# EasyEDA Pro project AgOopenHardwareMicro.eprj, board PCB_AIO v4.5 Micro AMP 2024 Robin
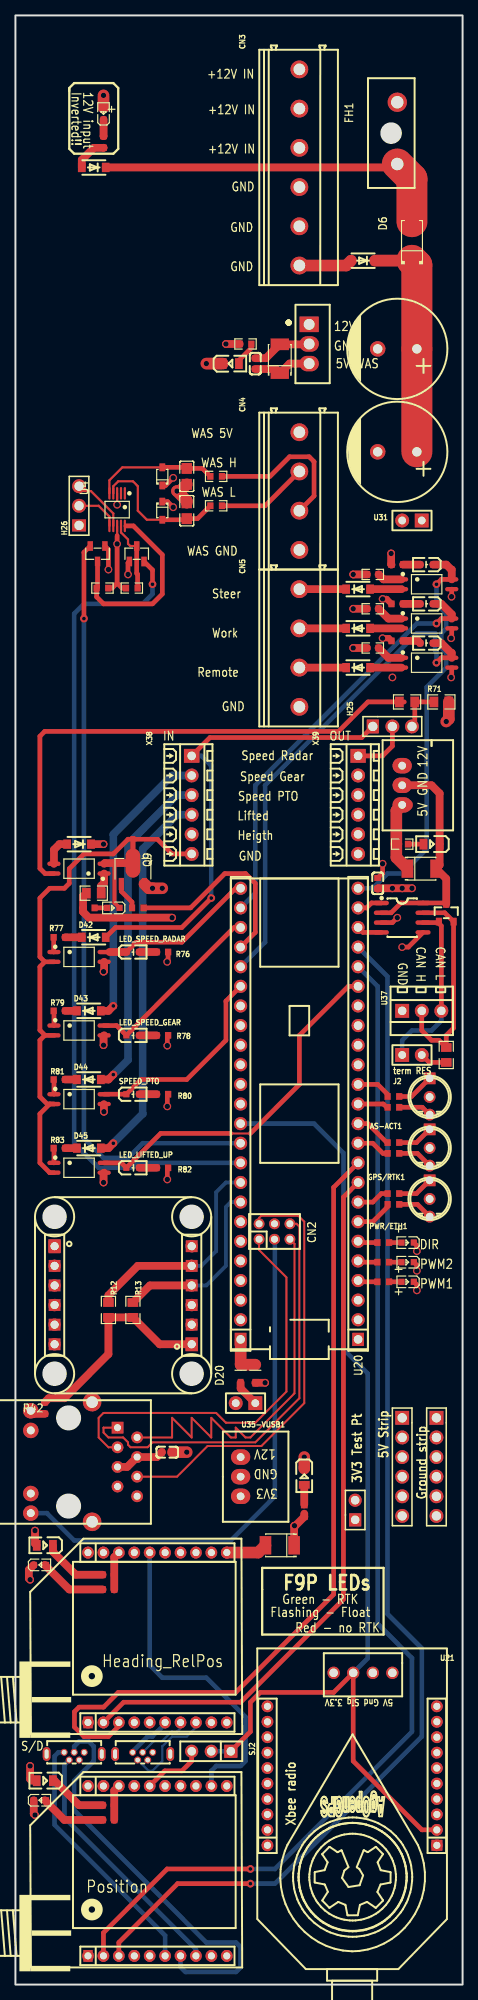
[diagram p12: board, top side]
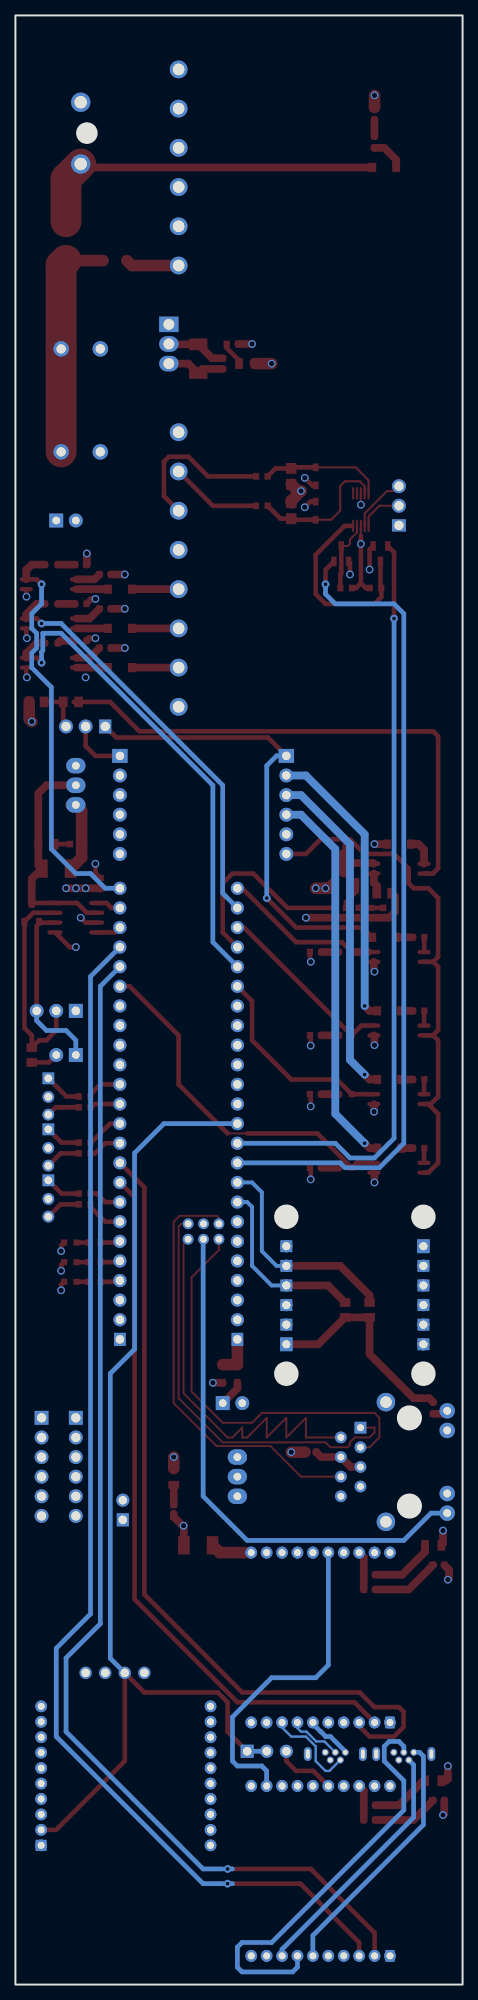
[diagram p13: board, bottom side, seen from below]

Outline 58 x 255 mm; copper layers: Top Layer, Inner1, Inner2, Bottom Layer. Coordinates in mm from the lower left corner of the outline.
Outline path: rectangle 0,255 58,0
Stack: Top Layer 0.035mm / Dielectric1 0.48mm PP er 4.5 / Inner1 0.035mm / Dielectric2 0.48mm FR4 er 4.5 / Inner2 0.035mm / Dielectric3 0.48mm PP er 4.5 / Bottom Layer 0.035mm

## Design rules (mm)
template: User Custom Config
spacing Default (default): track to track 0.201, other pairs 0 to 0.201
spacing 5v: track to track 0.201, other pairs 0 to 0.201
spacing 12v: track to track 0.3, other pairs 0 to 0.3
spacing sec: track to track 0.201, other pairs 0 to 0.201
track width Default (default): min 0.254, default 0.254, max 25.4
track width 5v: min 0.599, default 0.599, max 25.4
track width 12v: min 1.501, default 1.501, max 25.4
track width sec: min 0.5, default 0.5, max 25.4
differential pair differentialPair (default): width min 0.127, default 0.254, max 2.54; gap min 0.152, default 0.152
via Default (default): diameter min 0.61, default 0.61, max 100.025; hole min 0.305, default 0.305, max 59.995
via 5v: diameter min 0.8, default 0.8, max 100.025; hole min 0.399, default 0.399, max 59.995
via 12v: diameter min 1.001, default 1.001, max 100.025; hole min 0.599, default 0.599, max 59.995
via sec: diameter min 0.8, default 0.8, max 100.025; hole min 0.399, default 0.399, max 59.995
net 5V_WAS uses 5v, gge462106(1)
net 5V2 uses 5v, gge462106(1)
net +12V_BOARD uses 12v, gge462106
net +12V_IN uses 12v, gge462106(1)
net GND uses gge1424176(1)
net 3V3 uses gge462106
net 3.3V uses gge462106
pour e1032 uses gge462106

## Placement (name value [footprint] x y rotation side)
AS-ACT1  DY-339URUYGW/SN  [footprint_04ce]  53.73 115 270 top
C7  10nF  [footprint_89fb]  22.22 195.31 90 top
C8  100uF  [footprint_7bcb]  34.29 56.88 180 top
C9  100uF  [footprint_7bcb]  52.71 144.51 0 top
C10  100uF  [footprint_7bcb]  34.29 210.55 90 top
C11  100nF_CAN  [footprint_19ac]  46.99 142.61 270 top
C15  1000uF  [footprint_6613]  49.53 211.82 180 top
C16  100nF  [footprint_19ac]  31.12 209.91 90 top
C17  1000uF  [footprint_6613]  49.53 198.49 180 top
C23  10nF  [footprint_89fb]  22.22 190.87 270 top
C26  100nF  [footprint_19ac]  19.69 68.94 180 top
CN2  A2005HWV-2X3P  [footprint_9724]  33.6 97.52 0 top
CN3  DB128V-5.08-6P-GN-S  [CONN-TH_6P-P5.08_DIBO_DB128V-5.08]  36.83 235.31 270 top
CN4  DB128V-5.08-4P-GN-S  [CONN-TH_4P-P5.08_DIBO_DB128V-5.08]  36.83 193.41 270 top
CN5  DB128V-5.08-4P-GN-S  [CONN-TH_4P-P5.08_DIBO_DB128V-5.08]  36.83 173.09 270 top
D4  SM4007PL  [footprint_5765]  44.45 180.7 0 top
D5  PESD1CAN,215  [footprint_eecc]  55.88 138.8 270 top
D6  SS54_C22452  [footprint_14cd]  51.44 225.79 90 top
D7  SM4007PL  [footprint_5765]  45.09 223.25 180 top
D9  SM4007PL  [footprint_5765]  44.45 170.55 0 top
D11  SM4007PL  [footprint_5765]  44.45 175.62 0 top
D13  SM4007PL  [footprint_5765]  10.16 235.31 180 top
D14  SM4007PL  [footprint_5765]  8.25 147.69 180 top
D16  1N5819WS  [footprint_5a89]  19.05 195.31 90 top
D17  1N5819WS  [footprint_5a89]  19.05 190.87 270 top
D20  1N5819WS  [footprint_5976]  31.12 79.1 270 top
D41  1N5819WS  [footprint_5976]  29.21 79.1 270 top
D42  SM4007PL  [footprint_5765]  10.16 135.62 0 top
D43  SM4007PL  [footprint_5765]  9.53 126.09 0 top
D44  SM4007PL  [footprint_5765]  9.53 117.2 0 top
D45  SM4007PL  [footprint_5765]  9.53 108.31 0 top
FH1  178.6764.0001  [footprint_57e4]  49.53 239.76 270 top
GPS/RTK1  DY-339URUYGW/SN  [footprint_04ce]  53.73 108.4 270 top
H1  HEADER_2mm  [footprint_0abc]  18.42 33.94 0 top
H3  Ground  [footprint_dfc0]  54.61 67.04 270 top
H7  HEADER_2mm  [footprint_0abc]  18.42 55.94 0 top
H9  HEADER_2mm_XBEE  [footprint_0abc]  54.66 27.03 90 top
H10  HEADER_2mm_XBEE  [footprint_0abc]  32.69 27.03 90 top
H11  HEADER_2mm  [footprint_0abc]  18.42 3.72 0 top
H12  HEADER_2mm  [footprint_0abc]  18.42 25.72 0 top
H13  HEADER_6PINS  [footprint_c888]  5.08 89.26 270 top
H14  HEADER_6PINS  [footprint_c888]  22.86 89.26 90 top
H24  5V  [footprint_dfc0]  50.16 67.04 270 top
H25  2.54-1*3P针  [HDR-TH_3P-P2.54-V-M-1]  48.9 162.93 0 top
H26  2.54-1*3P针  [HDR-TH_3P-P2.54-V-M-1]  8.25 191.5 90 top
J2  MTP125-1102S1  [HDR-TH_2P-P2.54-V-M-1]  51.44 120.38 0 top
J3  3V3  [footprint_4a10]  44.07 61.45 90 top
LED3  RTK  [footprint_6589#2]  3.81 56.88 180 top
LED4  5V  [footprint_6589#2]  53.97 147.69 180 top
LED5  RTK  [footprint_6589#2]  3.81 26.4 180 top
LED7  5V WAS  [footprint_6589#2]  27.94 209.91 0 top
LED8  3V3  [footprint_6589]  37.47 65.77 270 top
LED9  PWM2_LED  [footprint_985f]  50.88 93.55 180 top
LED10  PWM1_LED  [footprint_985f]  50.88 91.01 180 top
LED11  DIR_LED  [footprint_985f]  50.88 96.09 180 top
LED12  SPEED_LED  [footprint_985f]  12.7 139.43 180 top
LED15  0603_RED  [footprint_985f]  3.17 54.34 0 top
LED16  0603_RED  [footprint_985f]  3.17 23.86 0 top
LED17  0603_RED  [footprint_985f]  11.43 242.3 90 top
LED_LIFTED_UP  Remote  [footprint_6b63]  15.24 105.78 0 top
LED_REMOTE1  Remote  [footprint_6b63]  53.34 173.72 180 top
LED_SPEED_GEAR  Remote  [footprint_6b63]  15.24 122.92 0 top
LED_SPEED_RADAR  Remote  [footprint_6b63]  15.24 133.72 0 top
LED_STEER1  Steer  [footprint_6b63]  53.34 183.88 180 top
LED_WORK1  Work  [footprint_6b63]  53.34 178.8 180 top
P2  RTK Radio  [footprint_4317]  45.09 40.37 180 top
PWR/ETH1  DY-339URUYGW/SN  [footprint_04ce]  53.73 101.8 270 top
Q4  2N7002  [footprint_df55]  10.65 185.29 90 top
Q5  2N7002  [footprint_df55]  15.73 185.29 270 top
Q9  D882_C9634  [footprint_acbf]  15.24 143.88 270 top
R1  270Ω  [footprint_eb8a]  46.35 182.61 180 top
R3  270Ω  [footprint_eb8a]  46.35 173.09 180 top
R6  1kΩ  [footprint_4e14]  12.06 23.22 180 top
R10  1kΩ  [footprint_4e14]  37.47 61.32 270 top
R12  2.2kΩ  [footprint_dc35]  12.06 87.36 270 top
R13  2.2kΩ  [footprint_dc35]  15.24 87.36 270 top
R16  270Ω  [footprint_eb8a]  46.35 178.16 180 top
R17  5.1kΩ  [footprint_76e4]  29.84 212.45 180 top
R18  1kΩ  [footprint_4e14]  11.43 238.62 270 top
R19  1kΩ  [footprint_4e14]  12.06 51.16 0 top
R20  1kΩ  [footprint_4e14]  49.53 174 180 top
R21  1kΩ  [footprint_4e14]  15.88 139.43 0 top
R22  5.1kΩ  [footprint_76e4]  15.1 180.85 0 top
R23  2kΩ  [footprint_4e14]  9.53 139.43 0 top
R26  1kΩ  [footprint_4e14]  12.06 21.32 0 top
R27  1kΩ  [footprint_4e14]  47.7 93.55 180 top
R28  1kΩ  [footprint_4e14]  47.7 91.01 180 top
R29  1kΩ  [footprint_4e14]  49.03 101.03 180 top
R30  1kΩ  [footprint_4e14]  49.03 102.43 180 top
R38  1kΩ  [footprint_4e14]  49.03 113.61 180 top
R39  1kΩ  [footprint_4e14]  49.03 115 180 top
R40  1kΩ  [footprint_4e14]  49.03 107.64 180 top
R41  1kΩ  [footprint_4e14]  49.03 109.04 180 top
R42  1kΩ  [footprint_4e14]  3.81 74.66 90 top
R48  200Ω  [footprint_dc35]  10.16 141.33 0 top
R51  1kΩ  [footprint_4e14]  47.7 96.09 180 top
R52  1kΩ  [footprint_4e14]  49.53 178.8 180 top
R53  1kΩ  [footprint_4e14]  49.53 183.88 180 top
R54  1kΩ  [footprint_4e14]  12.06 53.07 180 top
R61  5.1kΩ  [footprint_76e4]  50.16 147.69 0 top
R63  5.1kΩ  [footprint_76e4]  11.29 180.85 180 top
R64  120Ω  [footprint_dc35]  55.88 120.38 90 top
R71  2.2kΩ  [footprint_dc35]  55.25 166.1 0 top
R73  1.5kΩ  [footprint_76e4]  26.03 195.31 0 top
R74  1.5kΩ  [footprint_76e4]  26.03 191.5 0 top
R76  1kΩ  [footprint_4e14]  19.05 133.72 0 top
R77  1kΩ  [footprint_4e14]  5.72 135.62 180 top
R78  1kΩ  [footprint_4e14]  19.05 122.92 0 top
R79  1kΩ  [footprint_4e14]  5.72 126.09 180 top
R80  1kΩ  [footprint_4e14]  19.05 115.3 0 top
R81  1kΩ  [footprint_4e14]  5.72 117.2 180 top
R82  1kΩ  [footprint_4e14]  19.05 105.78 0 top
R83  1kΩ  [footprint_4e14]  5.72 108.31 180 top
R84  330Ω  [R0805]  50.8 166.1 0 top
REMOTEOPTO1  EL3H7(B)(TA)-G  [footprint_7a44]  53.34 171.18 0 top
REMOTEOPTO2  EL3H7(B)(TA)-G  [footprint_7a44]  8.25 133.08 0 top
REMOTEOPTO3  EL3H7(B)(TA)-G  [footprint_7a44]  8.25 123.56 0 top
REMOTEOPTO4  EL3H7(B)(TA)-G  [footprint_7a44]  8.25 114.67 0 top
REMOTEOPTO5  EL3H7(B)(TA)-G  [footprint_7a44]  8.25 105.78 0 top
RJ1  HR913550A  [footprint_28a5]  8.89 67.68 90 top
SJ2  PH2.54-01-03PZD  [HDR-TH_3P-P2.54-V-M]  25.4 30.21 180 top
SPEED_PTO  Remote  [footprint_6b63]  15.24 115.3 0 top
SPEEDPULSEOPTO1  EL3H7(B)(TA)-G  [footprint_7a44]  8.25 144.51 180 top
STEEROPTO1  EL3H7(B)(TA)-G  [footprint_7a44]  53.34 181.34 0 top
U3  K7803M-1000R3  [footprint_a0e4]  29.21 65.77 270 top
U4  ADS1115IDGSR  [footprint_a15c]  13.19 191.01 180 top
U5  Teensy/IMU Power  [footprint_8be4]  50.16 155.31 270 top
U6  MC7805CTG  [footprint_f649]  38.1 212.45 0 top
U11  Dual-Left  [footprint_247a]  18.41 44.94 90 top
U15  Ardfruit BNO085  [footprint_7c61]  2.54 94.34 90 top
U17  MCP2562-E/SN  [footprint_ae0f]  50.16 138.16 270 top
U18  Single/Dual-Right  [footprint_3ab3]  18.41 14.72 90 top
U20  TEENSY 4.1  [footprint_e0fd]  44.45 83.55 90 top
U21  LR_RADIO_XBEE_SOCKET  [footprint_2c55]  43.67 27.03 180 top
U29  H_TEENSY  [footprint_5514]  44.45 112.76 90 top
U30  H_TEENSY  [footprint_5514]  29.21 112.76 90 top
U31  MTP125-1102S1  [HDR-TH_2P-P2.54-V-M-1]  51.44 189.59 180 top
U35-VUSB1  MTP125-1102S1  [HDR-TH_2P-P2.54-V-M-1]  29.84 75.29 180 top
U37  DB125-2.54-3P-GN-S  [CONN-TH_DB125-2.54-3P-GN]  52.71 126.09 0 top
USB2  MICRO 180°JB  [footprint_5333]  7.62 29.57 180 top
USB3  MICRO 180°JB  [footprint_5333]  16.51 29.57 180 top
WORKOPTO1  EL3H7(B)(TA)-G  [footprint_7a44]  53.34 176.26 0 top
X38  MX128-2.54-06P-GN01-Cu-Y-A  [CONN-TH_6P-P2.54_MX128-2.54-6P]  22.86 152.76 270 top
X39  MX128-2.54-06P-GN01-Cu-Y-A  [CONN-TH_6P-P2.54_MX128-2.54-6P]  44.45 152.76 270 top

## Footprints (pads in the part's own frame, mm; a bottom-side part is the same pattern mirrored in y, then rotated)
CONN-TH_4P-P5.08_DIBO_DB128V-5.08
  round 2.3 hole 1.5: 1(-7.62,0) 2(-2.54,0) 3(2.54,0) 4(7.62,0)
CONN-TH_6P-P2.54_MX128-2.54-6P
  rect 1.8x2 hole 1.1: 1(-6.35,0)
  round 1.8 hole 1.1: 2(-3.81,0) 3(-1.27,0) 4(1.27,0) 5(3.81,0) 6(6.35,0)
CONN-TH_6P-P5.08_DIBO_DB128V-5.08
  round 2.3 hole 1.5: 1(-12.7,0) 2(-7.62,0) 3(-2.54,0) 4(2.54,0) 5(7.62,0) 6(12.7,0)
CONN-TH_DB125-2.54-3P-GN
  rect 1.8x1.8 hole 1.1: 1(-2.54,0)
  round 1.8 hole 1.1: 2(0,0) 3(2.54,0)
footprint_0abc
  round 1.524 hole 0.914: 1(-9,0) 2(-7,0) 3(-5,0) 4(-3,0) 5(-1,0) 6(1,0) 7(3,0) 8(5,0) 9(7,0) 10(9,0)
footprint_2c55
  rect 1.423x1.423 hole 0.701: 1(-10.998,9.005)
  round 1.423 hole 0.701: 2(-10.998,6.997) 3(-10.998,4.991) 4(-10.998,2.985) 5(-10.998,1.004) 6(-10.998,-1.004) 7(-10.998,-3.01) 8(-10.998,-5.016) 9(-10.998,-6.997) 10(-10.998,-9.005) 11(10.998,-9.005) 12(10.998,-6.997) 13(10.998,-5.016) 14(10.998,-3.01) 15(10.998,-1.004) 16(10.998,1.004) 17(10.998,2.985) 18(10.998,4.991) 19(10.998,6.997) 20(10.998,9.005)
footprint_3ab3
  rect 1.524x1.2 hole 0.75: 1(-11,9)
  oval 1.524x1.2 hole 0.75: 2(-11,7) 3(-11,5) 4(-11,3) 5(-11,1) 6(-11,-1) 7(-11,-3) 8(-11,-5) 9(-11,-7) 10(-11,-9) 11(11,-9) 12(11,-7) 13(11,-5) 14(11,-3) 15(11,-1) 16(11,1) 17(11,3) 18(11,5) 19(11,7) 20(11,9)
footprint_4a10
  rect 1.7x1.575 hole 1.1: 1(-1.27,0)
  round 1.7 hole 1.1: 2(1.27,0)
footprint_04ce
  rect 1.524x1.524 hole 1: 1(-2.349,0)
  round 1.524 hole 1: 2(0.059,0) 3(2.349,0)
footprint_4e14
  rect 0.806x0.864 smd: 1(-0.753,0) 2(0.753,0)
footprint_5a89
  rect 1x0.75 smd: 1(-1.173,0) 2(1.173,0)
footprint_6b63
  rect 0.8x0.8 smd: 1(0.851,0) 2(-0.851,0)
footprint_7a44
  oval 1.71x0.56 smd: 1(-3.255,0.635) 2(-3.255,-0.635) 3(3.255,-0.635) 4(3.255,0.635)
footprint_7bcb
  rect 1.506x2.376 smd: 1(-1.861,0) 2(1.861,0)
footprint_7c61
  rect 1.524x1.524 hole 1.016: 1(-11.43,-20.32) 2(-8.89,-20.32) 3(-6.35,-20.32) 4(-3.81,-20.32) 5(-1.27,-20.32) 6(1.27,-20.32) 7(1.27,-2.54) 8(-1.27,-2.54) 9(-3.81,-2.54) 10(-6.35,-2.54) 11(-8.89,-2.54) 12(-11.43,-2.54)
footprint_8be4
  oval 2x2.5 hole 1: 1(-2.54,0) 2(0,0) 3(2.54,0)
footprint_14cd
  rect 2.062x1.539 smd: 1(2.503,0) 2(-2.503,0)
footprint_19ac
  rect 0.8x0.9 smd: 1(-0.7,0) 2(0.7,0)
footprint_28a5
  rect 1.524x1.524 hole 0.9: 1(4.44,-4.355)
  round 1.524 hole 0.9: 2(3.18,-6.895) 3(1.9,-4.355) 4(0.64,-6.895) 5(-0.64,-4.355) 6(-1.9,-6.895) 7(-3.18,-4.355) 8(-4.44,-6.895)
  round 2 hole 1.02: 9(6.625,6.895) 10(4.085,6.895) 11(-4.085,6.895) 12(-6.625,6.895)
  round 2.4 hole 1.5: 13(7.75,-1.055) 14(-7.75,-1.055)
footprint_57e4
  round 2.5 hole 1.6: 1(-4,0) 2(4,0)
footprint_76e4
  rect 0.806x0.864 smd: 1(-0.753,0) 2(0.753,0)
footprint_89fb
  rect 1.41x1.35 smd: 1(-1.03,0) 2(1.03,0)
footprint_247a
  rect 1.524x1.2 hole 0.75: 1(-11,9)
  oval 1.524x1.2 hole 0.75: 2(-11,7) 3(-11,5) 4(-11,3) 5(-11,1) 6(-11,-1) 7(-11,-3) 8(-11,-5) 9(-11,-7) 10(-11,-9) 11(11,-9) 12(11,-7) 13(11,-5) 14(11,-3) 15(11,-1) 16(11,1) 17(11,3) 18(11,5) 19(11,7) 20(11,9)
footprint_985f
  rect 0.8x0.8 smd: 1(-0.799,-0.004) 2(0.799,0.004)
footprint_4317
  round 1.6 hole 1.1: 1(-3.81,0) 2(-1.27,0) 3(1.27,0) 4(3.81,0)
footprint_5333
  round 0.9 hole 0.6: 1(1.3,-0.5) 2(0.65,0.5) 3(0,-0.5) 4(-0.65,0.5) 5(-1.3,-0.5)
  oval 1x1.8 hole 0.5x1.2: 6(-3.575,-0.28) 7(3.575,-0.28)
footprint_5514
  rect 1.7x1.524 hole 1.1: 1(-29.21,0)
  round 1.7 hole 1.1: 2(-26.67,0) 3(-24.13,0) 4(-21.59,0) 5(-19.05,0) 6(-16.51,0) 7(-13.97,0) 8(-11.43,0) 9(-8.89,0) 10(-6.35,0) 11(-3.81,0) 12(-1.27,0) 13(1.27,0) 14(3.81,0) 15(6.35,0) 16(8.89,0) 17(11.43,0) 18(13.97,0) 19(16.51,0) 20(19.05,0) 21(21.59,0) 22(24.13,0) 23(26.67,0) 24(29.21,0)
footprint_5765
  rect 1x1.2 smd: 1(-1.55,0) 2(1.55,0)
footprint_5976
  rect 1x0.75 smd: 1(-1.173,0) 2(1.173,0)
footprint_6589
  rect 1x1.399 smd: 1(1.05,0)
  rect 0.6x1.399 smd: 2(-1.05,0)
footprint_6589#2
  rect 1x1.399 smd: 1(1.05,0) 2(-1.05,0)
footprint_6613
  round 2 hole 1.2: 1(-2.54,0) 2(2.54,0)
footprint_9724
  round 1.4 hole 0.9: 1(-2,-1) 2(-2,1) 3(0,-1) 4(0,1) 5(2,-1) 6(2,1)
footprint_a0e4
  oval 2x2.5 hole 1: 1(-2.54,0) 2(0,0) 3(2.54,0)
footprint_a15c
  oval 0.28x1.62 smd: 1(-1,-2.11) 2(-0.5,-2.11) 3(0,-2.11) 4(0.5,-2.11) 5(1,-2.11) 6(1,2.11) 7(0.5,2.11) 8(0,2.11) 9(-0.5,2.11) 10(-1,2.11)
footprint_acbf
  rect 1.575x0.672 smd: 1(1.357,-1.5) 3(1.357,1.5)
  custom 5.377x1.9 smd: 2(-1.356,0)
footprint_ae0f
  oval 0.569x1.95 smd: 1(-1.905,-2.705) 2(-0.635,-2.705) 3(0.635,-2.705) 4(1.905,-2.705) 5(1.905,2.705) 6(0.635,2.705) 7(-0.635,2.705) 8(-1.905,2.705)
footprint_c888
  rect 1.8x1.6 hole 1.02: 1(-6.35,0)
  round 1.6 hole 1.02: 2(-3.81,0) 3(-1.27,0) 4(1.27,0) 5(3.81,0) 6(6.35,0)
footprint_dc35
  rect 1.133x1.377 smd: 1(-0.966,0) 2(0.966,0)
footprint_df55
  rect 1.25x0.7 smd: 1(1,-0.95) 2(1,0.95) 3(-1,0)
footprint_dfc0
  rect 1.8x1.8 hole 1.2: 1(-6.35,0)
  round 1.8 hole 1.2: 2(-3.81,0) 3(-1.27,0) 4(1.27,0) 5(3.81,0) 6(6.35,0)
footprint_eb8a
  rect 0.806x0.864 smd: 1(-0.753,0) 2(0.753,0)
footprint_eecc
  rect 1x0.8 smd: 1(1.15,-0.95) 2(1.15,0.95) 3(-1.15,0)
footprint_f649
  rect 2.5x2 hole 1.4: 1(0,2.54)
  oval 2.5x2 hole 1.4: 2(0,0) 3(0,-2.54)
HDR-TH_2P-P2.54-V-M-1
  rect 1.8x1.8 hole 1: 1(-1.27,0)
  round 1.8 hole 1: 2(1.27,0)
HDR-TH_3P-P2.54-V-M
  rect 1.7x1.7 hole 1.1: 1(-2.54,0)
  round 1.7 hole 1.1: 2(0,0) 3(2.54,0)
HDR-TH_3P-P2.54-V-M-1
  rect 1.575x1.8 hole 1.2: 1(-2.54,0)
  round 1.8 hole 1.2: 2(0,0) 3(2.54,0)
R0805
  rect 1.133x1.377 smd: 1(-1,0) 2(1,0)

## Nets
As in the schematic, except:
$2N857: D6.1 D13.1 FH1.2
$5N1109: R42.1 RJ1.9
$5N1110: C26.2 RJ1.4 RJ1.5
$8N1393: H12.3 R6.1 R26.2 U18.18
$8N1395: H7.3 R19.2 R54.1 U11.18
$8N1474: LED15.2 R19.1
$8N1475: LED16.2 R26.1

Pads without a net: RJ1 7; U4 1 2; U29 2 3 16 17 18; U30 4 5 6 7 13 14 16 17 18; USB2 4 7; USB3 4 7

## Via types
v1: diameter 1, hole 0.7, Top Layer to Bottom Layer, 49 vias
v2: diameter 1.001, hole 0.7, Top Layer to Bottom Layer, 1 via
v3: diameter 1, hole 0.5, Top Layer to Bottom Layer, 11 vias

## Routing (per net, layer and track width the routed paths; a pad name or vN(x,y) marks a point on that pad's centre or on a via; arc(x,y) is an arc through that point)
3.3V: length 46.3
  Top Layer w0.6: v1(19.7,113.72) 19.7,115.2 R80.2 ; v1(12.06,183.25) 12.06,185.83 Q4.1 ; v1(14.6,182.61) 14.6,184.11 Q5.1 ; v1(19.69,132.44) 19.8,132.56 R76.2 ; v1(19.7,121.59) 19.7,122.82 R78.2 ; v1(50.16,134.35) 50.97,134.35 U17.5 ; v1(19.7,104.27) 19.7,105.67 R82.2
  Top Layer w0.8: 48.78,174 48.43,174.35 v1(47.62,174.35) ; v1(47.62,179.44) 48.14,179.44 48.78,178.8
  Top Layer w1: H14.1 18.72,82.91 R13.2 R12.2 12.06,81.65 6.35,75.93 4.33,75.93 R42.2 ; 48.78,183.88 48.74,183.92 v1(48.74,185.32)
  vias: v1(48.9,169.28)
3V3: length 8.7
  Top Layer w1: v1(2.54,58.78) 2.54,57.1 LED3.1 ; 37.47,60.97 R10.2 36.31,59.42 v1(36.19,59.42) 36.15,59.38 C8.1 ; 2.12,26.4 1.91,26.62 v1(1.91,28.31)
5V2: length 37.7
  Top Layer w0.6: v1(49.53,138.16) 48.9,137.53 U17.3
  Top Layer w1: D20.2 v1(32.38,77.93) ; R48.1 8.77,140.91 R23.1 8.77,138.91 9.53,138.16 v1(20.32,138.16) ; v1(51.44,141.97) v1(50.16,141.97) v1(48.9,141.97) 47.06,141.97 C11.2 ; v1(43.81,178.16) R16.2 ; v1(43.81,182.61) R1.2 ; v1(43.81,173.09) R3.2
  Top Layer w1.5: C9.1 49.41,145.94 R61.1 49.41,152.01 U5.3 50.8,152.76
5V_USB: length 33.2
  Bottom Layer w0.6: U18.6 19.41,6.35 5.08,20.69 5.08,29.57 5.58,30.07 USB2.1
5V_USB_1: length 6
  Bottom Layer w0.6: USB3.1 15.21,30.18 17.15,32.12 17.75,32.12 18.38,32.75 18.41,32.75 19.42,33.75 U11.6
5V_WAS: length 25.6
  Top Layer w0.28: 13.19,188.83 13.19,187.79
  Top Layer w0.6: D17.1 19.74,192.04 v1(20.47,191.31) ; v1(20.47,195.12) 19.48,194.14 D16.1 ; 13.19,187.65 v1(13.19,186.56) 13.19,181.48 ; 13.19,181.48 13.83,180.85 14.35,180.85 ; 13.19,181.48 12.56,180.85 R63.1
  Top Layer w1: U6.3 35.56,209.91 34.33,208.69 C10.1 33.76,209.22 C16.1 ; v1(27.31,212.45) R17.2
  Inner1 w0.6: 19.05,194.04 19.05,195.12 v1(20.47,195.12)
+12V_BOARD: length 32.6
  Top Layer w1.501: 51.4,223.25 D7.1 ; 51.4,223.25 51.44,223.25 ; 51.4,223.25 D6.2 ; v1(55.88,163.56) 56.21,163.89 R71.2
  Top Layer w4: C17.1 C15.1 52.07,222.65 D6.2
GND: length 84.3
  Top Layer w0.28: v2(13.19,191.64) U4.3
  Top Layer w0.6: v1(52.07,92.44) 52.07,93.16 LED9.1 ; LED10.1 52.07,90.62 v1(52.07,89.9) ; v1(56.51,169.28) 56.59,169.36 REMOTEOPTO1.3 ; 55.88,139.94 55.76,140.06 U17.8 50,140.06 48.74,138.8 U17.2 ; v1(56.56,179.73) 56.59,179.76 56.59,180.7 ; WORKOPTO1.3 56.59,174.44 v1(56.51,174.35) ; C11.1 47.62,143.94 v1(47.62,145.14) ; LED11.1 52.07,95.7 v1(52.07,94.98)
  Top Layer w1: LED16.1 2.38,22.12 v1(2.54,21.96) ; v1(11.43,103.87) 11.43,105.06 REMOTEOPTO5.3 ; 55.88,139.94 55.88,143.2 C9.2 55.03,144.97 LED4.2 55.03,154.25 53.97,155.31 U5.2 ; REMOTEOPTO3.3 11.43,122.84 v1(11.43,121.65) ; v1(1.91,52.44) 1.74,52.6 1.74,53.7 2.36,54.32 ; U6.2 38.06,212.41 C10.2 32.49,210.62 C16.2 ; REMOTEOPTO2.3 11.51,131.25 v1(11.43,131.18) ; D14.1 v1(11.43,147.69) ; v1(11.48,113.03) 11.48,114
  Top Layer w1.5: D7.2 42.9,222.62 CN3.6 ; U11.11 31.49,55.94 C8.2 ; LED17.2 11.42,243.1 v1(11.42,244.65) ; Q9.3 17.29,141.97 v1(17.78,141.97) v1(19.05,141.97) ; C7.1 21.35,193.41 v1(20.96,193.41) 22.22,192.13 C23.1 ; LED8.2 v1(37.47,68.31) ; v1(24.76,209.91) LED7.2 ; v1(22.22,68.94) 20.44,68.94
GND_X38: length 88.2
  Top Layer w0.6: X38.6 20.32,146.42 18.41,148.32 14.6,148.32 12.7,146.42 8.89,146.42 6.98,144.51 6.98,142.61 6.35,141.97 4.44,141.97 3.17,140.7 3.17,133.08 3.81,132.44 ; REMOTEOPTO4.2 4.44,114.03 ; 4.44,114.03 3.17,112.76 3.17,106.41 4.44,105.14 REMOTEOPTO5.2 ; 4.44,114.03 4.12,114.03 3.17,114.98 3.17,122.28 3.81,122.92 3.84,122.92 ; 3.81,132.44 3.17,131.81 3.17,123.59 3.84,122.92 ; 3.81,132.44 REMOTEOPTO2.2 ; 3.84,122.92 REMOTEOPTO3.2
  Inner2 w1: X38.6 X39.6
VIN: length 5.2
  Top Layer w1.5: D20.1 D41.1 U30.1
AS_ACT: length 4.6
  Top Layer w0.6: U29.14 46.99,116.57 48.28,115.28 R39.2
AS_STB: length 3.9
  Top Layer w0.6: 48.16,113.61 47.74,114.03 U29.13
CAN_H: length 27.8
  Top Layer w0.6: U37.2 52.71,123.56 53.97,122.28 54.94,122.28 R64.2 55.88,122.92 56.83,123.87 D5.2 55.68,138.8 U17.7
CAN_L: length 23
  Top Layer w0.6: 54.81,137.53 55.25,137.09 U37.3 ; 54.81,137.53 D5.1 ; 54.81,137.53 U17.6
  Bottom Layer w0.6: J2.1 50.16,122.28 51.44,123.56 53.97,123.56 55.25,124.83 U37.3
CANRX1: length 3.3
  Top Layer w0.6: U29.22 45.09,136.25 U17.4
CANTX1: length 3.3
  Top Layer w0.6: U29.23 45.55,139.43 46.19,140.06 U17.1
DATA_+: length 54.4
  Bottom Layer w0.6: USB2.3 7.62,30.84 8.25,31.48 9.53,31.48 10.16,30.84 10.16,28.94 7.62,26.4 7.62,22.59 24.76,5.44 28.61,5.44 29.21,4.84 29.21,2.24 28.61,1.63 22.05,1.63 21.41,2.27 U18.7
DATA_+_1: length 6.9
  Bottom Layer w0.3: U11.7 21.42,33.21 20.96,32.75 20.25,32.75 18.98,31.48 17.91,31.48 USB3.3
DATA_-: length 32.7
  Bottom Layer w0.6: USB2.2 6.35,28.46 6.35,21.63 23.41,4.56 U18.8
DATA_-_1: length 12.2
  Bottom Layer w0.3: U11.8 23.42,33.31 22.22,32.12 20.32,32.12 19.05,30.84 19.05,28.94 17.78,27.67 17.26,27.67 USB3.2
DIR: length 2.6
  Top Layer w0.6: R51.2 44.61,96.09 U29.6
ETH_LED: length 68.8
  Bottom Layer w0.6: 2,61.05 4.08,61.05 7.62,57.51 27.94,57.51 33.66,63.23 33.66,96.47 CN2.3
ETHERNET: length 4.3
  Top Layer w0.6: R30.2 47.46,102.43 46.35,101.33 U29.8
F9P: length 8.1
  Top Layer w0.6: U18.16 19.37,27.67 21.59,27.67 22.86,28.94 SJ2.3
GPSFIX: length 4.4
  Top Layer w0.6: U29.11 46.35,108.95 47.67,107.64 R40.2
HEIGTH: length 21.6
  Inner2 w1: X38.5 X39.5
LIFTED: length 71.3
  Top Layer w1: D45.2 12.06,108.31 v3(12.7,108.95)
  Inner2 w1: X38.4 X39.4
  Bottom Layer w1: X38.4 20.96,151.5 16.51,147.05 16.51,112.76 v3(12.7,108.95)
LIFTED_TEENSY: length 46.7
  Top Layer w0.254: 27.94,110.22 30.48,110.22
  Top Layer w0.6: U29.19 43.18,129.27 36.83,122.92 36.83,116.57 30.48,110.22 ; 27.94,110.22 18.83,110.22 LED_LIFTED_UP.2 13.75,106.41 REMOTEOPTO5.4
POWERON: length 4.9
  Top Layer w0.6: U29.7 46.35,98.79 48.28,100.71 R29.2
PWM1: length 2.6
  Top Layer w0.6: R28.2 44.61,91.01 U29.4
PWM2: length 2.6
  Top Layer w0.6: R27.2 44.61,93.55 U29.5
R+: length 53.5
  Top Layer w0.254: CN2.1 31.6,95.13 35.15,91.58 35.15,76.79 31.12,72.75 27.31,72.75 26.03,74.03 11.43,74.03 10.79,73.39 10.79,70.85 12.07,69.57 RJ1.3
R-: length 56.2
  Top Layer w0.254: RJ1.6 15.79,65.77 20.96,65.77 24.92,69.74 31.91,69.74 37.47,75.29 37.47,98.79 36.71,99.55 31.87,99.55 31.6,99.28 CN2.2
REMOTEPIN: length 6.7
  Top Layer w1: D9.1 36.19,170.55
REMOTETEENSY: length 64.7
  Top Layer w0.6: REMOTEOPTO1.4 55.25,171.81 v3(54.61,171.18)
  Top Layer w1: REMOTEOPTO1.4 56.59,172.45 56.51,172.45 55.25,173.72 LED_REMOTE1.2
  Bottom Layer w0.6: U30.20 32.38,134.99 32.38,155.31 52.07,174.99 54.44,174.99 54.44,172.75 54.61,172.6 v3(54.61,171.18)
RTKFIX: length 4.7
  Top Layer w0.6: U29.12 45.72,111.49 48.17,109.04
RX1: length 155.7
  Top Layer w0.6: U18.2 11.41,6.7 19.69,14.97 v3(30.48,14.97)
  Bottom Layer w0.6: 31.12,14.97 33.66,14.97 51.44,32.75 51.44,42.28 46.99,46.72 46.99,129.27 U29.20 ; 29.84,14.97 v3(30.48,14.97)
RX2: length 92.5
  Top Layer w0.6: U29.9 42.54,101.97 42.54,49.9 29.21,36.56 14.03,36.56 U11.2
RX3: length 135.1
  Top Layer w0.6: 54.67,20.04 52.72,20.04 43.81,28.94 P2.3 41.28,37.83 31.75,37.83 30.48,36.56 30.48,32.75 SJ2.1
  Bottom Layer w0.6: P2.3 45.69,42.25 45.69,79.13 42.54,82.28 42.54,107.68 38.74,111.49 U30.12 ; SJ2.2 SJ2.1
SCL0: length 23.8
  Top Layer w1: R13.1 17.45,90.53 H14.4
  Bottom Layer w0.5: H14.4 24.76,90.53 27.31,93.07 27.31,100.69 27.94,101.33 U30.8
SCL_HV: length 25.4
  Top Layer w0.6: Q4.3 10.65,180.96 R63.2 10.54,179.69 11.43,178.8 17.78,178.8 19.05,180.07 19.05,185.15 15.3,188.9 14.33,188.9
SCL_LV: length 99.2
  Top Layer w0.6: v3(8.89,176.9) 8.89,185.48 Q4.2
  Bottom Layer w0.6: v3(8.89,176.9) 8.89,109.58 11.43,107.05 14.6,107.05 16.51,108.95 U30.11
SDA0: length 28.6
  Top Layer w1: R12.1 12.06,89.26 15.88,93.07 H14.5
  Bottom Layer w0.5: U30.9 27.31,103.87 26.03,102.6 26.03,94.98 24.13,93.07 H14.5
SDA_HV: length 9.4
  Top Layer w0.28: U4.9 13.69,188.05 14.6,187.14 14.6,186.57 14.88,186.29 Q5.3
  Top Layer w0.6: R22.2 15.85,182.63 15.73,182.75 Q5.3
SDA_LV: length 107.6
  Top Layer w0.6: v3(17.78,181.34) 17.78,183.19 Q5.2
  Bottom Layer w0.6: U30.10 15.88,106.41 15.24,105.78 10.79,105.78 7.62,108.95 7.62,177.53 8.89,178.8 16.51,178.8 17.78,180.07 v3(17.78,181.34)
SPEED+: length 5.8
  Top Layer w0.6: H25.3 51.8,163.29 R84.2 R71.1
SPEED_GEAR: length 59
  Top Layer w1: v3(12.7,126.73) 12.06,126.09 D43.2
  Inner2 w1: X38.2 X39.2
  Bottom Layer w1: v3(12.7,126.73) 12.7,148.95 20.32,156.57 X38.2
SPEED_GEAR_TEENSY: length 24
  Top Layer w0.6: U30.22 28.36,136.89 LED_SPEED_GEAR.2 13.12,124.19 REMOTEOPTO3.4
SPEED_PTO: length 65
  Top Layer w1: v3(12.7,117.84) 12.06,117.2 D44.2
  Inner2 w1: X38.3 X39.3
  Bottom Layer w1: X38.3 20.96,154.03 14.6,147.69 14.6,119.75 v3(12.7,117.84)
SPEED_PTO_TEENSY: length 26.5
  Top Layer w0.6: REMOTEOPTO4.4 SPEED_PTO.2 16.29,117.2 22.22,117.2 27.31,122.28 27.31,127.36 U30.19
SPEED_RADAR: length 7.5
  Top Layer w0.6: H25.2 48.9,160.38 47.62,159.12 X39.1
SPEED_RADAR_TEENSY: length 20.4
  Top Layer w0.6: U30.24 28.57,141.97 21.59,134.99 15.66,134.99 LED_SPEED_RADAR.2
  Top Layer w1: LED_SPEED_RADAR.2 12.21,133.72
SPEEDPULSE: length 25.9
  Top Layer w0.6: R21.2 22.72,139.43 27.16,143.88 29.84,143.88 31.12,142.61 31.12,136.25 U30.21
STEERPIN: length 6.1
  Top Layer w1: D4.1 CN5.1
STEERTEENSY: length 53.6
  Top Layer w0.6: v3(54.61,181.34) 55.25,181.97 STEEROPTO1.4
  Top Layer w1: LED_STEER1.2 55.88,183.88 56.51,183.25 56.59,183.25 STEEROPTO1.4
  Bottom Layer w0.6: v3(54.61,181.34) 54.61,178.8 55.88,177.53 55.88,175.62 55.25,174.99 55.25,173.09 55.88,172.45 55.88,170.55 53.34,168 53.34,147.05 50.16,143.88 48.26,143.88 46.35,141.97 U29.24
T+: length 55.6
  Top Layer w0.254: CN2.6 36.47,98.52 36.83,98.16 36.83,75.93 31.12,70.22 17.78,70.22 17.15,69.58 14.93,69.58 14.6,69.9 14.6,70.22 13.97,70.85 12.06,70.85 11.43,71.49 11.43,72.11 11.43,72.12 RJ1.1 13.25,71.57
T-: length 55.5
  Top Layer w0.254: RJ1.2 15.79,70.85 20.32,70.85 20.32,73.39 22.86,70.85 22.86,73.39 25.4,70.85 25.4,73.39 27.94,70.85 28.57,70.85 28.57,72.12 29.84,70.85 30.49,70.85 36.19,76.56 36.19,95.93 CN2.5
T_VUSB: length 3.4
  Top Layer w1: D41.2 29.21,77.2 U35-VUSB1.1
TX1: length 157.7
  Top Layer w0.6: v3(30.48,13.06) 21.03,13.06 13.41,5.44 U18.3
  Bottom Layer w0.6: 31.12,13.06 33.66,13.06 52.71,32.12 52.71,43.54 48.26,47.99 48.26,130.54 U29.21 ; 29.84,13.06 v3(30.48,13.06)
TX2: length 106.4
  Top Layer w0.6: U11.3 13.41,33.47 12.06,32.12 8.89,32.12 7.66,33.35 7.66,35.32 8.25,35.93 11.43,35.93 13.34,37.83 28.57,37.83 41.28,50.53 41.28,103.24 U29.10
WAS_H: length 11.9
  Top Layer w0.6: CN4.2 32.38,191.5 R74.2
WAS_L: length 20.4
  Top Layer w0.6: CN4.3 38.74,192.77 38.74,197.22 38.1,197.85 35.56,197.85 33.02,195.31 R73.2
WORKPIN: length 6.7
  Top Layer w1: D11.1 36.19,175.62
WORKTEENSY: length 54.6
  Top Layer w0.6: v3(54.61,176.26) 55.25,176.9 56.59,176.9
  Top Layer w1: LED_WORK1.2 55.25,178.8 56.59,177.45 56.59,176.9
  Bottom Layer w0.6: v3(54.61,176.26) 52.07,176.26 31.12,155.31 31.12,141.33 U30.23
$2N857: length 46.3
  Top Layer w1: 11.71,235.31 48.45,235.31 48.9,235.76 FH1.2
  Top Layer w4: D6.1 51.44,233.85 FH1.2
$2N868: length 2.1
  Top Layer w1: LED17.1 11.43,239.37 R18.1
$2N869: length 4.5
  Top Layer w1: R18.2 11.42,237.85 10.16,237.85 8.61,236.31 D13.2
$2N2134: length 2
  Top Layer w0.6: R61.2 LED4.1
$2N4039: length 3.2
  Top Layer w0.6: LED7.1 28.99,210.33 30.6,211.94 R17.1
$2N4060: length 2.5
  Top Layer w1: LED8.1 37.47,62.18
$3N834: length 16
  Top Layer w0.28: D16.2 13.87,196.48 12.19,194.8 U4.5
  Top Layer w0.6: R73.1 24.25,196.34 C7.2 22.08,196.48 D16.2
$3N857: length 18.4
  Top Layer w0.28: D17.2 17.05,189.69 15.88,190.87 15.88,194.04 15.24,194.68 13.34,194.68 12.69,194.03 U4.4
  Top Layer w0.6: R74.1 23.62,189.84 C23.2 22.08,189.69 D17.2
$3N1928: length 5.7
  Top Layer w0.28: H26.2 10.79,191.5 12.19,190.1 U4.6
$3N1938: length 7.5
  Top Layer w0.28: H26.3 8.89,193.41 9.8,193.41 12.69,190.51 U4.7
$4N682: length 3.5
  Top Layer w1: 50.09,176.9 48.38,176.9 R16.1
$4N683: length 3.2
  Top Layer w1: R1.1 47.74,181.97 STEEROPTO1.1
$4N684: length 3.5
  Top Layer w1: R3.1 48.38,171.81 REMOTEOPTO1.1
$4N688: length 2.2
  Top Layer w1: R52.1 LED_WORK1.1
$4N689: length 2.2
  Top Layer w1: LED_STEER1.1 R53.1
$4N690: length 2.3
  Top Layer w1: LED_REMOTE1.1 52.2,174 R20.1
$4N1067: length 4.1
  Top Layer w1: D11.2 WORKOPTO1.2
$4N1069: length 4.1
  Top Layer w1: REMOTEOPTO1.2 D9.2
$4N1248: length 2.2
  Top Layer w1: R76.1 LED_SPEED_RADAR.1
$4N1557: length 1.9
  Top Layer w0.6: REMOTEOPTO2.1 4.96,133.75 R77.2
$4N1559: length 2.1
  Top Layer w1: R77.1 D42.1
$4N1719: length 2.2
  Top Layer w1: R78.1 LED_SPEED_GEAR.1
$4N1720: length 1.9
  Top Layer w0.6: R79.2 5,126.06 REMOTEOPTO3.1
$4N1722: length 1.5
  Top Layer w1: R79.1 D43.1
$4N1885: length 2.2
  Top Layer w1: R80.1 SPEED_PTO.1
$4N1886: length 1.9
  Top Layer w0.6: REMOTEOPTO4.1 5,117.17 R81.2
$4N1888: length 1.5
  Top Layer w1: R81.1 D44.1
$4N2051: length 2.2
  Top Layer w1: R82.1 LED_LIFTED_UP.1
$4N2052: length 1.9
  Top Layer w0.6: REMOTEOPTO5.1 5,108.28 R83.2
$4N2054: length 1.5
  Top Layer w1: R83.1 D45.1
$4N2393: length 61.1
  Top Layer w0.6: D42.2 12.98,136.89 21.59,136.89 v3(25.4,140.7) ; H25.1 44.92,161.49 25.24,161.49 X38.1
  Bottom Layer w0.6: X38.1 24.13,159.12 25.4,157.84 v3(25.4,140.7)
$4N2442: length 4.1
  Top Layer w1: D4.2 50.09,180.7
$5N1109: length 2
  Top Layer w1: 2,74.3 2.39,73.91 R42.1
$5N1110: length 6.5
  Top Layer w1: C26.2 18.99,68.94 18.37,68.31 RJ1.4 14.5,67.03 RJ1.5
$6N225: length 1.6
  Top Layer w0.6: R51.1 50.08,96.09 LED11.2
$6N226: length 1.6
  Top Layer w0.6: R28.1 50.08,91.01 LED10.2
$6N227: length 1.6
  Top Layer w0.6: R27.1 50.08,93.55 LED9.2
$6N647: length 4.7
  Top Layer w0.6: R41.1 52.01,109.04 GPS/RTK1.1
$6N649: length 4.6
  Top Layer w0.6: GPS/RTK1.3 52.14,107.64 R40.1
$6N651: length 4.9
  Top Layer w0.6: R39.1 51.38,115 AS-ACT1.1
$6N653: length 4.3
  Top Layer w0.6: 53.73,112.66 52.77,113.61 R38.1
$6N656: length 4.7
  Top Layer w0.6: R30.1 52.01,102.43 PWR/ETH1.1
$6N657: length 4.6
  Top Layer w0.6: PWR/ETH1.3 52.14,101.03 R29.1
$8N1393: length 4.6
  Top Layer w1: U18.18 12.82,25.12 R6.1 R26.2
$8N1395: length 5
  Top Layer w1: R19.2 R54.1 12.82,55.35 U11.18
$8N1397: length 42.4
  Bottom Layer w0.6: U11.16 17.41,41.37 19.05,39.74 24.76,39.74 29.84,34.66 29.84,28.94 29.21,28.31 26.03,28.31 26.03,28.29 25.41,27.67 U18.12
$8N1474: length 8.8
  Top Layer w1: R19.1 6.98,51.16 3.81,54.34
$8N1475: length 8.6
  Top Layer w1: R26.1 6.35,21.32 3.81,23.86
$8N1488: length 7.8
  Top Layer w1: LED5.2 5.08,26.4 8.25,23.22 R6.2
$8N1489: length 8.5
  Top Layer w1: LED3.2 4.86,56.05 7.84,53.07 R54.2
$9N252: length 3.6
  Top Layer w0.6: R64.1 53.67,119.41 J2.2
$10N571: length 2.7
  Top Layer w1: R48.2 11.13,142.3 11.51,142.69 SPEEDPULSEOPTO1.1
$10N572: length 9.8
  Top Layer w0.5: LED12.1 12.84,140.09 12.84,145.23
  Top Layer w1: 11.51,145.14 11.6,145.23 Q9.2
$10N584: length 1.6
  Top Layer w0.6: LED12.2 11.9,139.43 R23.2
$10N586: length 3.7
  Top Layer w0.6: Q9.1 13.74,141.56 15.12,140.18 R21.1
$10N1472: length 68.3
  Top Layer w0.6: SPEEDPULSEOPTO1.4 3.84,143.88 3.17,144.55 3.17,161.66 3.81,162.29 41.91,162.29 45.72,166.1 R84.1 50.44,166.1
$10N1558: length 3.8
  Top Layer w1: D14.2 5.72,147.69 5,146.97 5,145.14

## Copper pours and planes (outline as drawn; the poured copper is in the pictures)
3.3V on Inner2: 17.57,73.34 29.84,73.34 29.84,83.15 45.32,83.15 45.72,131.57 51.55,131.52 51.55,136.25 18.48,136.25 18.48,157.79 42.25,157.79 41.91,183.8 41.83,183.88 46.99,183.88 46.99,167.68 51.44,167.68 51.44,190.69 32.25,190.69 32.25,184.26 11.43,184.26 11.43,129.27 17.15,129.27 17.57,128.84
3V3 on Inner2: -1.08,-1.1 -1.27,65.77 45.86,65.77 46.31,20.71 59.47,20.71 59.47,-1.1
5V2 on Inner2: 59.06,21.96 47,21.95 47,66.61 35.07,66.61 35.07,73.69 30.87,73.69 30.87,82.5 46.43,82.5 46.43,130.98 52.2,130.98 52.2,137.24 19.08,137.24 19.08,143.88 43.18,143.88 42.54,183.25 46.32,183.25 46.32,167.37 48.1,167.37 48.1,154.63 58.42,154.63
5V_WAS on Inner2: 11.43,213.72 11.37,185.15 31.44,185.15 31.44,191.66 41.75,191.66 41.75,213.72
+12V_BOARD on Inner2: 59.06,227.69 -1.15,227.69 -1.27,66.41 34.29,66.41 34.29,72.75 16.51,72.75 16.51,128.63 10.16,128.63 10.43,214.9 42.74,214.9 42.54,191.49 51.9,191.49 51.9,167.4 48.51,167.4 48.51,155.36 58.5,155.28
+12V_IN on Inner2: 31.12,254.37 57.15,254.37 57.15,239.76 43.06,239.76 43.06,234.68 31.12,234.68
GND on Top Layer: 33.66,255.63 33.33,163.38 43,163.38 42.39,143.88 -5.12,143.88 -5.38,143.61 -5.38,-3.14 -4.44,-4.08 59.06,-4.08 59.06,255
GND on Bottom Layer: -12.06,259.44 67.94,259.44 67.94,-10.43 -12.06,-10.43
GND on Inner1: -8.64,256.27 67.31,255.63 67.31,-25.55 -9.21,-25.04

## Text on the board
Top Silkscreen Layer: 5V Gnd Sig 3.3V | term RES | S/D | IN | WAS GND | WAS 5V | Remote | WAS H | WAS L | +12V IN | Steer | Work | GND | Lifted | Heigth | Speed PTO | Speed Gear | Speed Radar | OUT | CAN H | CAN L | + | Flashing - Float | Green - RTK | Red - no RTK | 12V | 5V WAS | Inverted!! | 12V input | DIR | PWM2 | PWM1 | 3V3 | 5V | 3V3 Test Pt | 5V Strip | Ground strip | Xbee radio | Position | Heading_RelPos | F9P LEDs | Change log / - "no pads" Teensy footprint / - replaced C16133 100uF Tantalum to correct JLCPCB rotation conflict / - replaced green 0603 LEDs with 0805
